# EasyEDA Pro project BlueberryPi.eprj, schematic BlueberryPi Board, sheets 9 to 13 of 13 (continued)
## Sheets (continued)
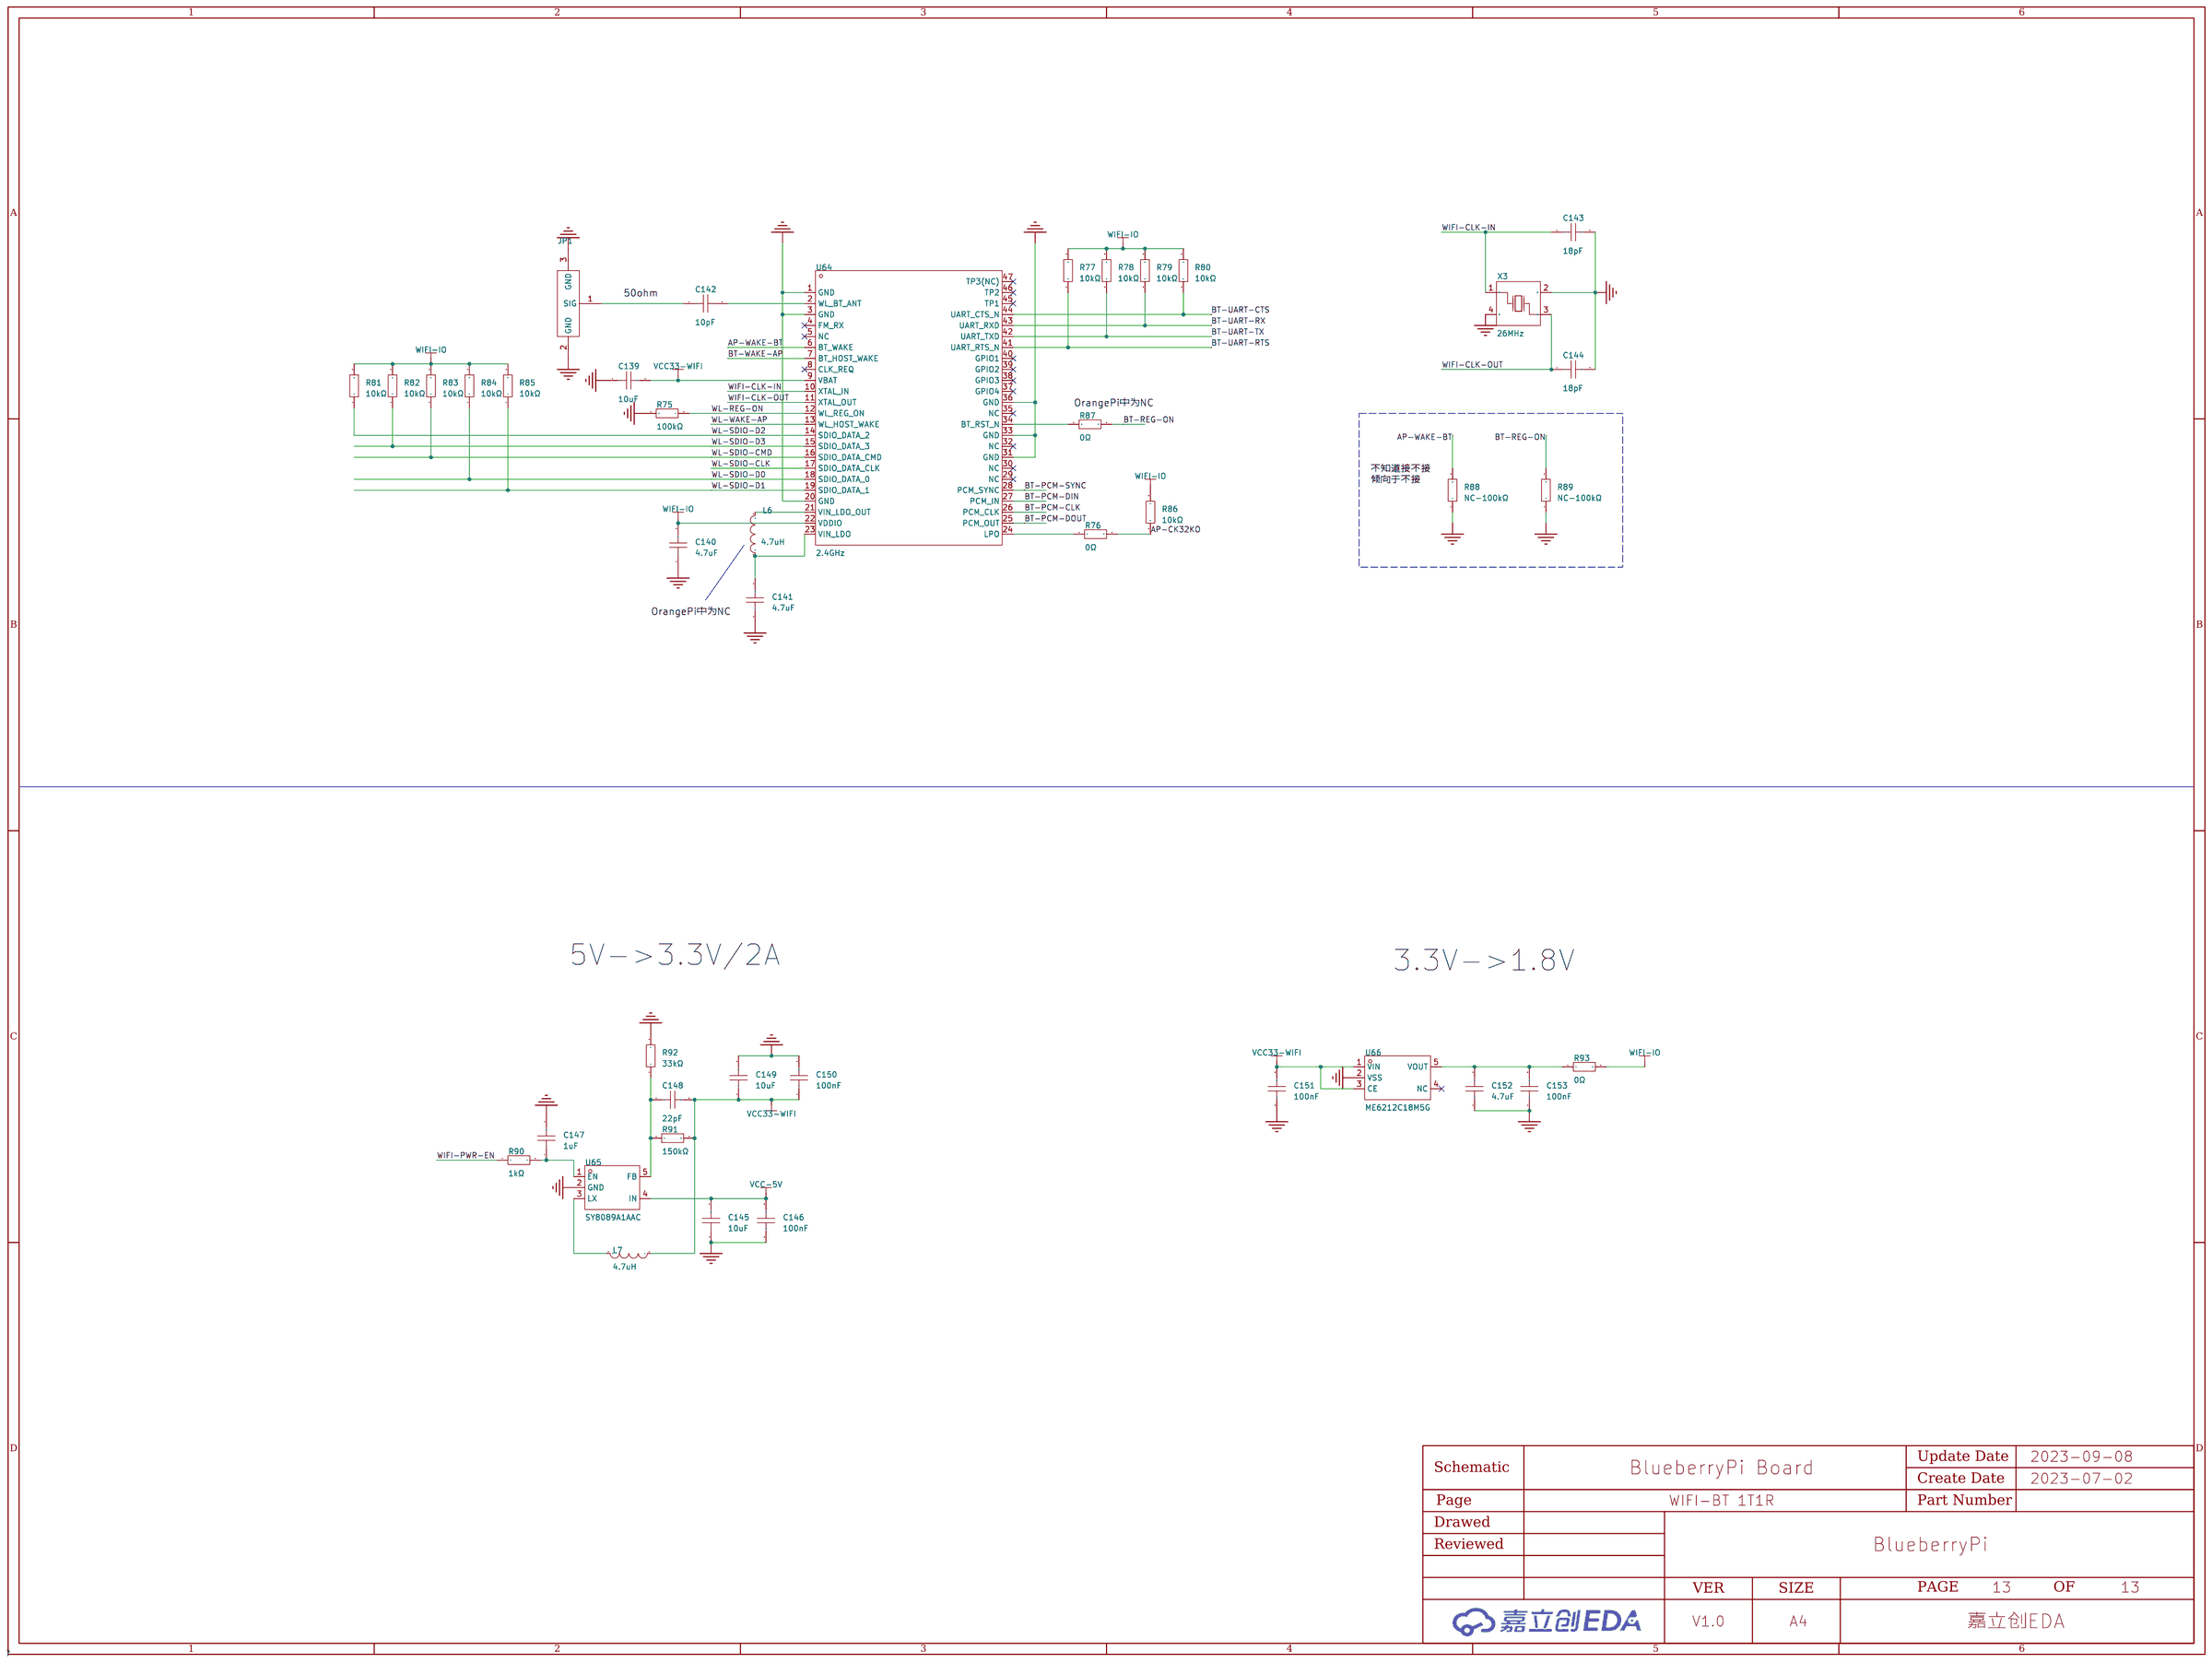
[diagram p12: WIFI-BT 1T1R]

## Parts
sheet AV-HDMI
AUDIO1  PJ-327C-4A  [AUDIO-SMD_PJ-327C-4A]
C136  4.7uF  [C0603]
C137  4.7uF  [C0603]
C138  100nF  [C0402]
CN1  KH-HDMI-19P-Cu  [HDMI-SMD_KH-HDMI-19P-CU]
D3  AZ1045-04F.R7G  [DFN2510-10_L2.5-W1.0-P0.50-BL]
D4  AZ1045-04F.R7G  [DFN2510-10_L2.5-W1.0-P0.50-BL]
D5  1N5819WS  [SOD-323_L1.8-W1.3-LS2.5-RD]
D6  1N5819WS  [SOD-323_L1.8-W1.3-LS2.5-RD]
Q2  BSN20  [SOT-23-3_L2.9-W1.6-P1.90-LS2.8-BR]
Q3  BSN20  [SOT-23-3_L2.9-W1.6-P1.90-LS2.8-BR]
Q4  BSN20  [SOT-23-3_L2.9-W1.6-P1.90-LS2.8-BR]
R63  0Ω  [R0402]
R64  0Ω  [R0402]
R65  10kΩ  [R0402]
R66  10kΩ  [R0402]
R67  1.8kΩ  [R0402]
R68  0Ω  [R0402]
R69  10K  [R0402]
R70  10kΩ  [R0402]
R71  1.8kΩ  [R0402]
R72  56kΩ  [R0402]
R73  56kΩ  [R0402]
U59  -  [DFN1006-2L_L1.0-W0.6-P0.70-BI]
U60  -  [DFN1006-2L_L1.0-W0.6-P0.70-BI]
U61  -  [DFN1006-2L_L1.0-W0.6-P0.70-BI]
U62  -  [DFN1006-2L_L1.0-W0.6-P0.70-BI]
U63  -  [DFN1006-2L_L1.0-W0.6-P0.70-BI]
sheet CARD-USB
C125  100nF  [C0603]
C126  10uF  [C0603]
C127  100nF  [C0402]
C128  100nF  [C0402]
C129  10uF  [C0603]
C130  100nF  [C0402]
C131  10uF  [C0603]
CARD1  TF-01A  [TF-SMD_TF-01A]
D2  AZ1045-04F.R7G  [DFN2510-10_L2.5-W1.0-P0.50-BL]
R46  10kΩ  [R0402]
R47  47kΩ  [R0402]
R48  0Ω  [R0603]
R49  10kΩ  [R0402]
R50  6.8kΩ  [R0402]
R51  10kΩ  [R0402]
R52  6.8kΩ  [R0402]
R53  10kΩ  [R0402]
R54  6.8kΩ  [R0402]
U40  -  [DFN1006-2L_L1.0-W0.6-P0.70-BI]
U41  -  [DFN1006-2L_L1.0-W0.6-P0.70-BI]
U42  -  [DFN1006-2L_L1.0-W0.6-P0.70-BI]
U43  -  [DFN1006-2L_L1.0-W0.6-P0.70-BI]
U44  -  [DFN1006-2L_L1.0-W0.6-P0.70-BI]
U45  -  [DFN1006-2L_L1.0-W0.6-P0.70-BI]
U47  -  [DFN1006-2L_L1.0-W0.6-P0.70-BI]
U49  -  [DFN1006-2L_L1.0-W0.6-P0.70-BI]
U50  SY6280AAC  [SOT-23-5_L3.0-W1.7-P0.95-LS2.8-BL]
U51  -  [DFN1006-2L_L1.0-W0.6-P0.70-BI]
U52  -  [DFN1006-2L_L1.0-W0.6-P0.70-BI]
U53  SY6280AAC  [SOT-23-5_L3.0-W1.7-P0.95-LS2.8-BL]
U54  SY6280AAC  [SOT-23-5_L3.0-W1.7-P0.95-LS2.8-BL]
U55  -  [DFN1006-2L_L1.0-W0.6-P0.70-BI]
U56  -  [DFN1006-2L_L1.0-W0.6-P0.70-BI]
U57  -  [DFN1006-2L_L1.0-W0.6-P0.70-BI]
U58  -  [DFN1006-2L_L1.0-W0.6-P0.70-BI]
USB2  906-162A1011D10200  [USB-A-TH_4P-P1.40-V-F-C39416]
USB3  USB-303WSD-BRY  [USB-A-TH_XUNPU_USB-303WSD-BRY]
sheet eMMC-GPIO
C119  2.2uF  [C0402]
C120  100nF  [C0402]
C121  100nF  [C0402]
C122  100nF  [C0402]
C123  100nF  [C0402]
C124  100nF  [C0402]
R42  10kΩ  [R0402]
R43  10kΩ  [R0402]
R44  2kΩ  [R0603]
R45  2kΩ  [R0603]
U7  MTP125-1213S1  [HDR-TH_26P-P2.54-V-M-R2-C13-S2.54]
U39  KLMAG1JETD-B041  [FBGA-153_L13.0-W11.5-P0.50_KLMAG1JETD-B041]
sheet KEY-LED-DEBUG
C132  4.7nF  [C0402]
C133  100nF  [C0402]
C134  100nF  [C0402]
C135  470nF  [C0402]
H1  -  [HDR-TH_3P-P2.54-V-F]
LED1  -  [LED_0603]
LED2  -  [LED_0603]
Q1  BSN20  [SOT-23-3_L2.9-W1.6-P1.90-LS2.8-BR]
R55  0Ω  [R0402]
R56  10kΩ  [R0402]
R57  330Ω  [R0603]
R58  330Ω  [R0603]
R59  1kΩ  [R0402]
R60  1kΩ  [R0402]
R61  1kΩ  [R0402]
R62  10kΩ  [R0402]
SW1  TS342A2P-WZ  [SW-SMD_L4.0-W2.9-LS5.0]
SW2  TS342A2P-WZ  [SW-SMD_L4.0-W2.9-LS5.0]
SW3  TS342A2P-WZ  [SW-SMD_L4.0-W2.9-LS5.0]
SW4  TS342A2P-WZ  [SW-SMD_L4.0-W2.9-LS5.0]
U25  -  [DFN1006-2L_L1.0-W0.6-P0.70-BI]
sheet WIFI-BT 1T1R
C139  10uF  [C0603]
C140  4.7uF  [C0603]
C141  4.7uF  [C0603]
C142  10pF  [C0402]
C143  18pF  [C0402]
C144  18pF  [C0402]
C145  10uF  [C0603]
C146  100nF  [C0402]
C147  1uF  [C0402]
C148  22pF  [C0402]
C149  10uF  [C0603]
C150  100nF  [C0402]
C151  100nF  [C0603]
C152  4.7uF  [C0603]
C153  100nF  [C0402]
JP1  U.FL-R-SMT-1(80)  [RF-SMD_FRF05002-JSS103M]
L6  4.7uH  [IND-SMD_L6.0-W6.0_FNR60XXS]
L7  4.7uH  [IND-SMD_L6.0-W6.0_FNR60XXS]
R75  100kΩ  [R0402]
R76  0Ω  [R0402]
R77  10kΩ  [R0402]
R78  10kΩ  [R0402]
R79  10kΩ  [R0402]
R80  10kΩ  [R0402]
R81  10kΩ  [R0402]
R82  10kΩ  [R0402]
R83  10kΩ  [R0402]
R84  10kΩ  [R0402]
R85  10kΩ  [R0402]
R86  10kΩ  [R0402]
R87  0Ω  [R0402]
R88  100kΩ  [R0402]
R89  100kΩ  [R0402]
R90  1kΩ  [R0402]
R91  150kΩ  [R0402]
R92  33kΩ  [R0402]
R93  0Ω  [R0402]
U64  2.4GHz  [QFN-44_L12.0-W12.0-P0.90-TL_AP6212]
U65  SY8089A1AAC  [TSOT-23-5_L2.9-W1.6-P0.95-LS2.8-BR]
U66  ME6212C18M5G  [SOT-23-5_L3.0-W1.7-P0.95-LS2.8-BL]
X3  26MHz  [CRYSTAL-SMD_4P-L3.2-W2.5-BL]

## Library data of the parts
AUDIO1 = PJ-327C-4A: 连接器类型:3.5mm耳机座;额定电流:500mA;额定电压:30V;; LCSC Part Name: 3.5mm耳机座; Supplier Part: C145813; Manufacturer: 韩国韩荣; Supplier Footprint: SMD; JLCPCB Part Class: 扩展库; Datasheet: https://atta.szlcsc.com/upload/public/pdf/source/20191118/C145813_26F674D71028FA4AF82A3DC8E43D6931.pdf; Supplier: LCSC; Connector Type: 3.5mm耳机座; Current Rating (Max): 500mA; Voltage Rating (Max): 30V
C136 C137 C140 C141 C152 = CL10A475KA8NQNC: 容值:4.7uF;精度:±10%;额定电压:25V;材质(温度系数):X5R;; LCSC Part Name: 4.7uF ±10% 25V; Supplier Part: C69335; Manufacturer: SAMSUNG(三星); Supplier Footprint: 0603; JLCPCB Part Class: Extended Part; Datasheet: https://atta.szlcsc.com/upload/public/pdf/source/20161108/1478586410580.pdf; Supplier: LCSC; Tolerance: ±10%; Voltage Rated: 25V; Temperature Coefficient: X5R
C120-C124 C127 C128 C130 C133 C134 C138 C146 C150 C153 = 0402B104K250NT: 容值:100nF;精度:±10%;额定电压:25V;材质(温度系数):X7R;; LCSC Part Name: 100nF ±10% 25V; Supplier Part: C56392; Manufacturer: FH(风华); Supplier Footprint: 0402; JLCPCB Part Class: Extended Part; Datasheet: https://atta.szlcsc.com/upload/public/pdf/source/20200305/C486355_26A10D38EF8C2A5C37091D0039909270.pdf; Supplier: LCSC; Tolerance: ±10%; Voltage Rated: 25V; Temperature Coefficient: X7R
CN1 = KH-HDMI-19P-Cu: 连接器类型:HDMI;公母:母;总PIN位数:19P;排数:-;安装方式:卧贴;额定电流:-;工作温度范围:-;; LCSC Part Name: HDMI 母 P数:19P; Supplier Part: C709361; Manufacturer: kinghelm(金航标); Supplier Footprint: SMD; JLCPCB Part Class: Extended Part; Datasheet: https://atta.szlcsc.com/upload/public/pdf/source/20211208/D47DE7411E98B8CA58BDDFA754B04DEC.pdf; Supplier: LCSC; Connector Type: HDMI; Gender: 母; Number of Pins: 19P; Mounting Style: 卧贴
D2-D4 = AZ1045-04F.R7G: LCSC Part Name: ESD 编带; Supplier Part: C356811; Manufacturer: AMAZING(晶焱); Supplier Footprint: DFN2510P10E; JLCPCB Part Class: 扩展库; Datasheet: https://atta.szlcsc.comnull; Supplier: LCSC
D5 D6 = 1N5819WS_C191023: 直流反向耐压(Vr):40V;平均整流电流(Io):1A;正向压降(Vf):600mV@1A;; LCSC Part Name: 40V 1A 600mV@1A; Supplier Part: C191023; Manufacturer: Hottech(合科泰); Supplier Footprint: SOD-323; JLCPCB Part Class: 基础库; Datasheet: https://atta.szlcsc.com/upload/public/pdf/source/20180614/C191023_3C6A6398B911F3A4C23E7538EE054643.pdf; Supplier: LCSC; Reverse Voltage (Vr): 40V; Average Rectified Current (Io): 1A; Forward Voltage (Vf@If): 600mV@1A
Q1-Q4 = BSN20_C116157: 类型:N沟道;漏源电压(Vdss):50V;连续漏极电流(Id):100mA;功率(Pd):-;导通电阻(RDS(on)@Vgs,Id):3.5Ω@5V,200mA;阈值电压(Vgs(th)@Id):1.5V@1mA;; LCSC Part Name: N沟道 50V 100mA; Supplier Part: C116157; Manufacturer: SHIKUES(时科); Supplier Footprint: SOT-23(SOT-23-3); JLCPCB Part Class: 扩展库; Datasheet: https://atta.szlcsc.com/upload/public/pdf/source/20170721/C116157_1500622630262834583.pdf; Supplier: LCSC; Type: N沟道; Drain Source Voltage (Vdss): 50V; Continuous Drain Current (Id): 100mA; Drain Source On Resistance (RDS(on)@Vgs,Id): 3.5Ω@5V,200mA; Gate Threshold Voltage (Vgs(th)@Id): 1.5V@1mA
R55 R63 R64 R68 R76 R87 R93 = 0402WGF0000TCE: 电阻类型:厚膜电阻;阻值:0Ω;精度:±1%;功率:62.5mW;; LCSC Part Name: 0Ω ±1% 62.5mW; Supplier Part: C17168; Manufacturer: UNI-ROYAL(厚声); Supplier Footprint: 0402; JLCPCB Part Class: Basic Part; Datasheet: https://atta.szlcsc.com/upload/public/pdf/source/20200306/C422600_1E6D84923E4A46A82E41ADD87F860B5C.pdf; Supplier: LCSC; Type: 厚膜电阻; Tolerance: ±1%; Power(Watts): 62.5mW; Temperature Coefficient: ±800ppm/℃; Overload Voltage (Max): 50V; Operating Temperature Range: -55℃~+155℃
R42 R43 R46 R49 R51 R53 R56 R62 R65 R66 R70 R77-R86 = 0402WGF1002TCE: 电阻类型:厚膜电阻;阻值:10kΩ;精度:±1%;功率:62.5mW;; LCSC Part Name: 10kΩ ±1% 62.5mW; Supplier Part: C25744; Manufacturer: UNI-ROYAL(厚声); Supplier Footprint: 0402; JLCPCB Part Class: Basic Part; Datasheet: https://atta.szlcsc.com/upload/public/pdf/source/20200306/C422600_1E6D84923E4A46A82E41ADD87F860B5C.pdf; Supplier: LCSC; Type: 厚膜电阻; Tolerance: ±1%; Power(Watts): 62.5mW; Temperature Coefficient: ±100ppm/℃; Overload Voltage (Max): 50V; Operating Temperature Range: -55℃~+155℃
R67 R71 = 0402WGF1801TCE: 电阻类型:厚膜电阻;阻值:1.8kΩ;精度:±1%;功率:62.5mW;; LCSC Part Name: 1.8kΩ ±1% 62.5mW; Supplier Part: C25871; Manufacturer: UNI-ROYAL(厚声); Supplier Footprint: 0402; JLCPCB Part Class: Extended Part; Datasheet: https://atta.szlcsc.com/upload/public/pdf/source/20200306/C422600_1E6D84923E4A46A82E41ADD87F860B5C.pdf; Supplier: LCSC; Type: 厚膜电阻; Tolerance: ±1%; Power(Watts): 62.5mW; Temperature Coefficient: ±100ppm/℃; Overload Voltage (Max): 50V; Operating Temperature Range: -55℃~+155℃
R69 = Res_0402: Supplier Footprint: 0402
R72 R73 = 0402WGF5602TCE: 电阻类型:厚膜电阻;阻值:56kΩ;精度:±1%;功率:62.5mW;; LCSC Part Name: 56kΩ ±1% 62.5mW; Supplier Part: C25796; Manufacturer: UNI-ROYAL(厚声); Supplier Footprint: 0402; JLCPCB Part Class: Basic Part; Datasheet: https://atta.szlcsc.com/upload/public/pdf/source/20200306/C422600_1E6D84923E4A46A82E41ADD87F860B5C.pdf; Supplier: LCSC; Type: 厚膜电阻; Tolerance: ±1%; Power(Watts): 62.5mW; Temperature Coefficient: ±100ppm/℃; Overload Voltage (Max): 50V; Operating Temperature Range: -55℃~+155℃
U25 U40-U45 U47 U49 U51 U52 U55-U63 = ESD5451N: Supplier: LCSC; Datasheet: https://atta.szlcsc.com/upload/public/pdf/source/20211227/D040CF3F0222548C5BD9F7E690946783.pdf; Manufacturer: TECH PUBLIC(台舟); Supplier Part: C2936977; JLCPCB Part Class: 扩展库; Check: false
C125 C151 = 0603B104K500NT: 容值:100nF;精度:±10%;额定电压:50V;材质(温度系数):X7R;; LCSC Part Name: 100nF ±10% 50V; Supplier Part: C30926; Manufacturer: FH(风华); Supplier Footprint: 0603; JLCPCB Part Class: Extended Part; Datasheet: https://atta.szlcsc.com/upload/public/pdf/source/20170923/C30926_1506149436298988724.pdf; Supplier: LCSC; Tolerance: ±10%; Voltage Rated: 50V; Temperature Coefficient: X7R
C126 C129 C131 C139 C145 C149 = GRM188R61E106KA73D: 容值:10uF;精度:±10%;额定电压:25V;材质(温度系数):X5R;; LCSC Part Name: 10uF ±10% 25V; Supplier Part: C344022; Manufacturer: muRata(村田); Supplier Footprint: 0603; JLCPCB Part Class: Extended Part; Datasheet: https://atta.szlcsc.com/upload/public/pdf/source/20181211/C344022_BB98D43E7DA95E5A749FBFE073C8A3E0.pdf; Supplier: LCSC; Tolerance: ±10%; Voltage Rated: 25V; Temperature Coefficient: X5R
CARD1 = TF-01A_C91145: 工作温度范围:-;本体最大高度:-;触头镀层:-;连接器类型:卡座;卡类型:MicroSD卡(TF卡);焊接温度(最大值):-;触头材质:-;卡连接方式:自弹式;; Supplier Part: C91145; Manufacturer: 韩国韩荣; Supplier Footprint: SMD; JLCPCB Part Class: Extended Part; Datasheet: https://atta.szlcsc.com/upload/public/pdf/source/20190322/C91145_63CBD6FB4639A3A3EC6A9721F18AE0FB.pdf; Supplier: LCSC; Connector Type: 卡座; Card Type: MicroSD卡(TF卡); Card Connection Mode: 自弹式
R47 = 0402WGF4702TCE: 电阻类型:厚膜电阻;阻值:47kΩ;精度:±1%;功率:62.5mW;; LCSC Part Name: 47kΩ ±1% 62.5mW; Supplier Part: C25792; Manufacturer: UNI-ROYAL(厚声); Supplier Footprint: 0402; JLCPCB Part Class: Basic Part; Datasheet: https://atta.szlcsc.com/upload/public/pdf/source/20200306/C422600_1E6D84923E4A46A82E41ADD87F860B5C.pdf; Supplier: LCSC; Type: 厚膜电阻; Tolerance: ±1%; Power(Watts): 62.5mW; Temperature Coefficient: ±100ppm/℃; Overload Voltage (Max): 50V; Operating Temperature Range: -55℃~+155℃
R48 = 0603WAF0000T5E: 电阻类型:厚膜电阻;阻值:0Ω;精度:±1%;功率:100mW;; LCSC Part Name: 0Ω ±1% 100mW; Supplier Part: C21189; Manufacturer: UNI-ROYAL(厚声); Supplier Footprint: 0603; JLCPCB Part Class: Basic Part; Datasheet: https://atta.szlcsc.com/upload/public/pdf/source/20200306/C422600_1E6D84923E4A46A82E41ADD87F860B5C.pdf; Supplier: LCSC; Type: 厚膜电阻; Tolerance: ±1%; Power(Watts): 100mW; Overload Voltage (Max): 75V; Operating Temperature Range: -55℃~+155℃
R50 R52 R54 = 0402WGF6801TCE: 电阻类型:厚膜电阻;阻值:6.8kΩ;精度:±1%;功率:62.5mW;; LCSC Part Name: 6.8kΩ ±1% 62.5mW; Supplier Part: C25917; Manufacturer: UNI-ROYAL(厚声); Supplier Footprint: 0402; JLCPCB Part Class: Basic Part; Datasheet: https://atta.szlcsc.com/upload/public/pdf/source/20200306/C422600_1E6D84923E4A46A82E41ADD87F860B5C.pdf; Supplier: LCSC; Type: 厚膜电阻; Tolerance: ±1%; Power(Watts): 62.5mW; Temperature Coefficient: ±100ppm/℃; Overload Voltage (Max): 50V; Operating Temperature Range: -55℃~+155℃
U50 U53 U54 = SY6280AAC_C55136: 低能耗配电开关; Supplier Part: C55136; Manufacturer: silergy(矽力杰); Supplier Footprint: SOT-23-5; JLCPCB Part Class: Extended Part; Datasheet: https://atta.szlcsc.com/upload/public/pdf/source/20161108/1478586372822.pdf; Supplier: LCSC
USB2 = 906-162A1011D10200: 连接器类型:Type-A;标准:USB 2.0;公母:母座;触点数量:4;端口数量:1;安装方式:侧插;额定电流 - 电源:2A;工作温度范围:-;; LCSC Part Name: Type-A 母座 侧插 短体三直脚无边铜壳PBT白胶; Supplier Part: C39417; Manufacturer: 精拓金; Supplier Footprint: 插件; JLCPCB Part Class: Extended Part; Supplier: LCSC; Connector Type: Type-A; Standard: USB 2.0; Gender: 母座; Number of Contacts: 4; Number of Ports: 1; Mounting Style: 侧插; Current Rating - Power (Max): 2A
USB3 = USB-303WSD-BRY: 连接器类型:Type-A;标准:USB 3.0;公母:母座;触点数量:9+9;端口数量:2;安装方式:弯插;额定电流 - 电源:1.8A;工作温度范围:-30℃~+85℃;焊接温度(最大值):260℃;; LCSC Part Name: Type-A 母座 弯插 双层9短体; Supplier Part: C2895028; Manufacturer: XUNPU(讯普); Supplier Footprint: 插件; JLCPCB Part Class: Extended Part; Supplier: LCSC; Connector Type: Type-A; Standard: USB 3.0; Gender: 母座; Number of Contacts: 9+9; Number of Ports: 2; Mounting Style: 弯插; Current Rating - Power (Max): 1.8A; Operating Temperature Range: -30℃~+85℃; Welding Temperature (Max): 260℃